# EasyEDA Pro project wukong01-Y003-HTOL - 2.eprj, board PCB1
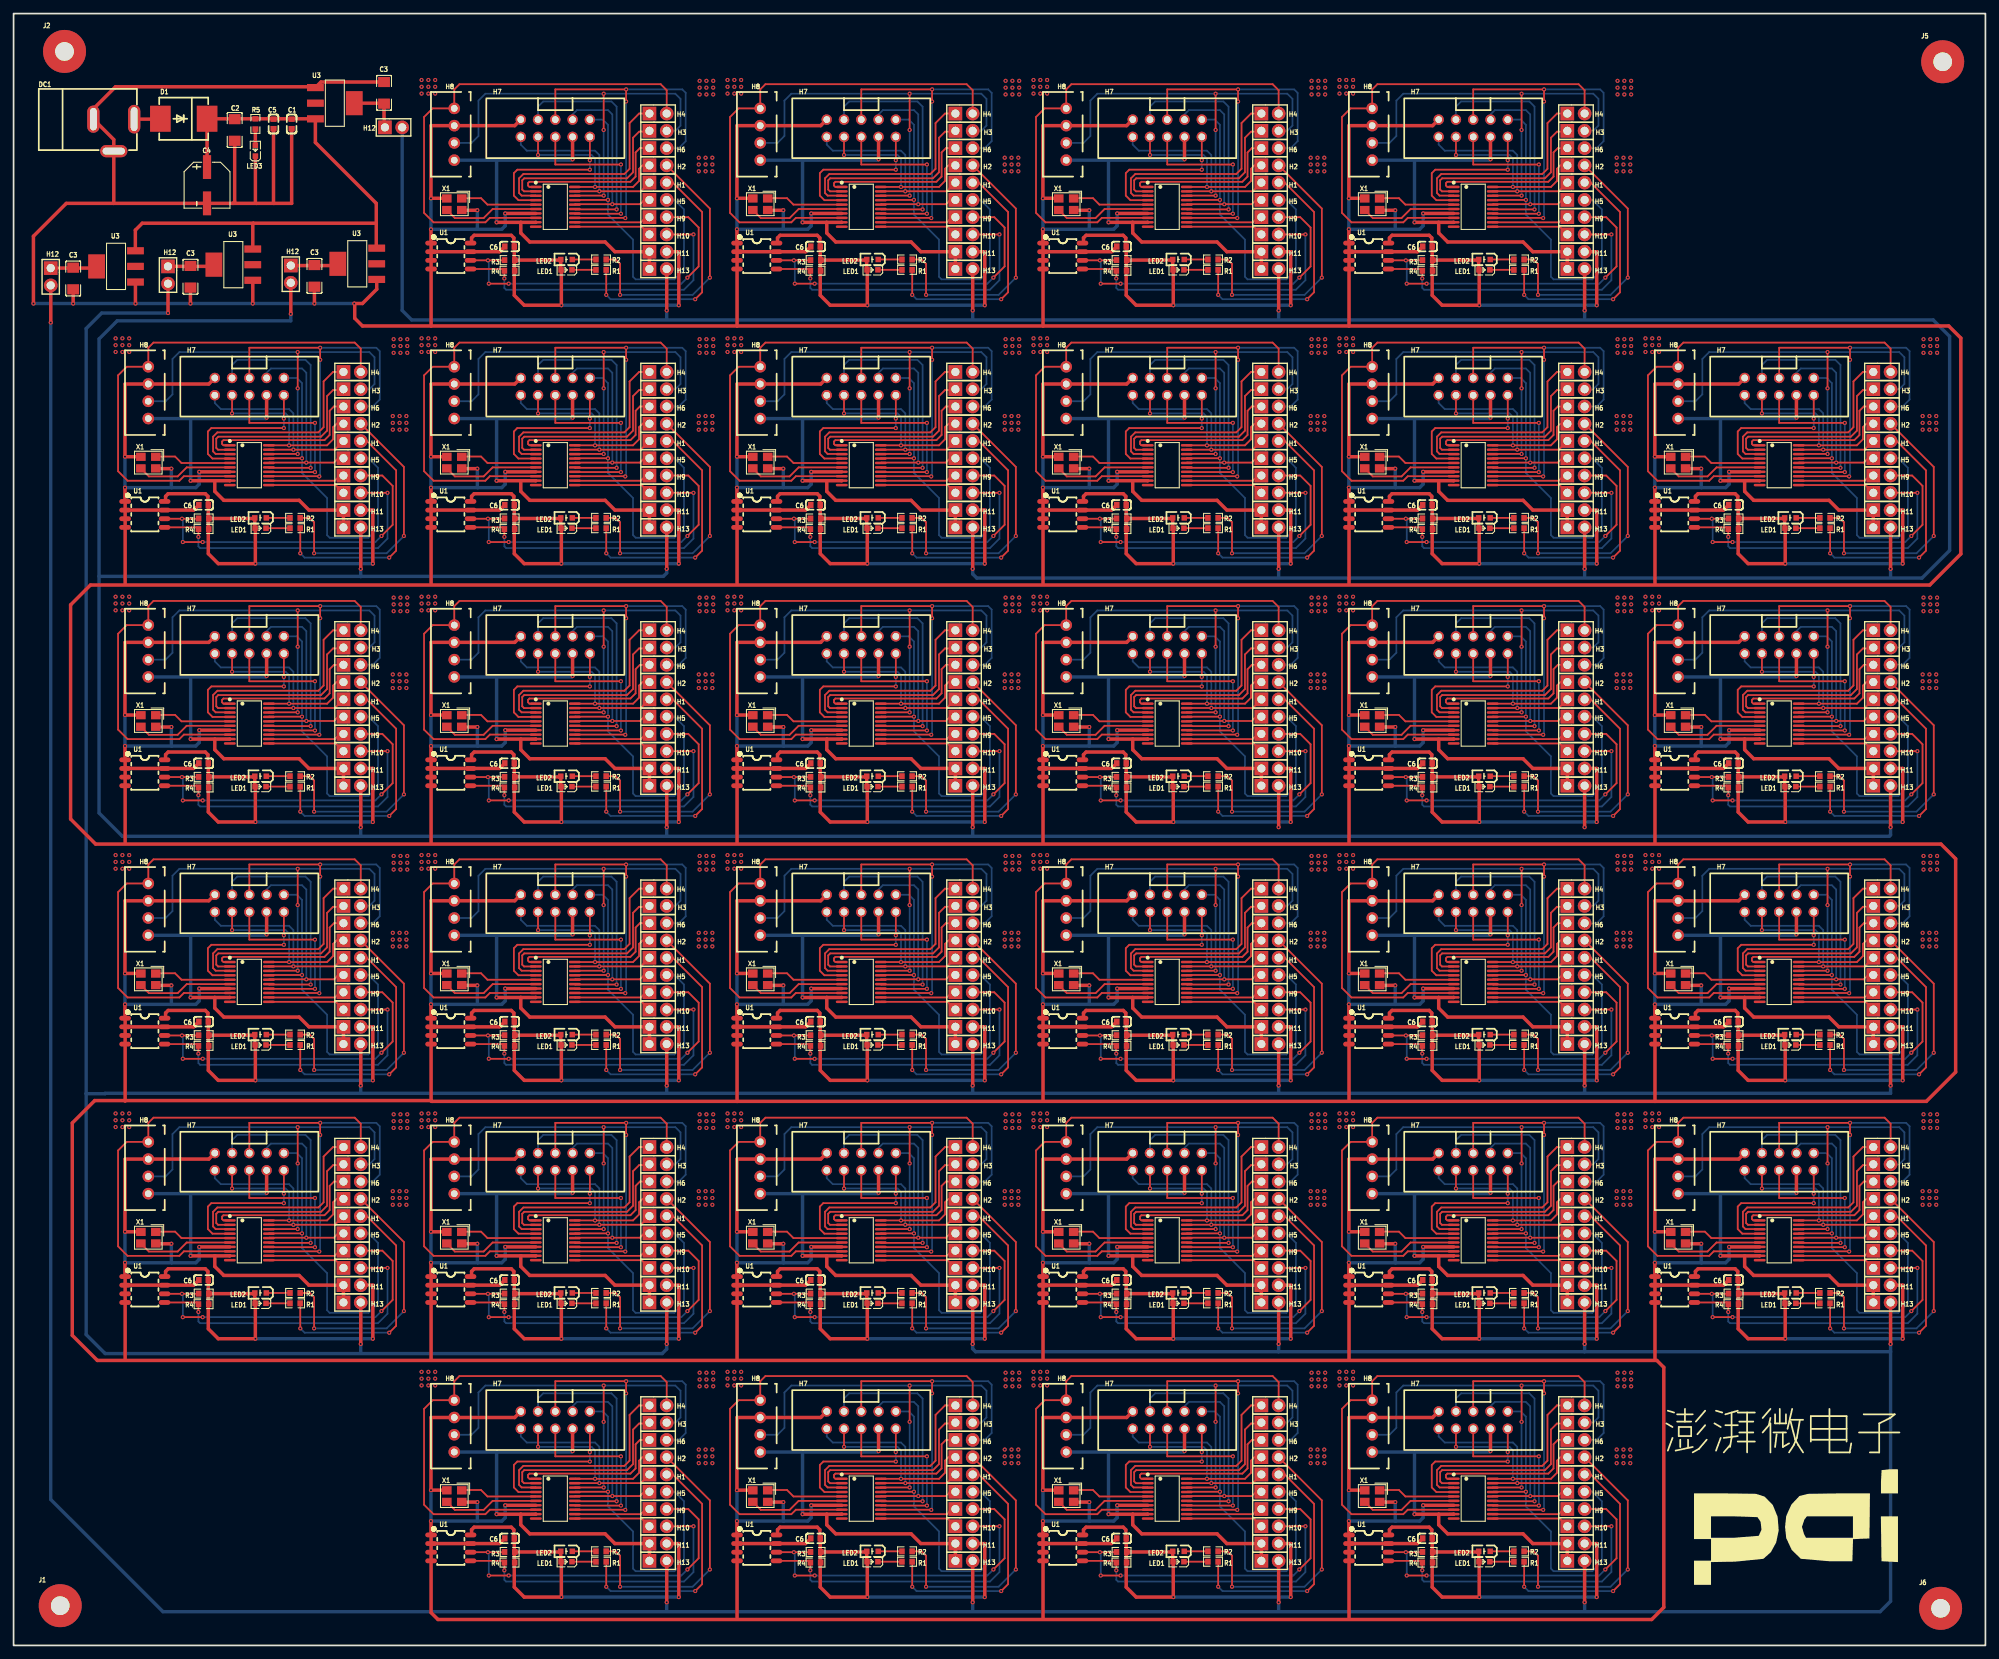
[diagram p1: board, top side]
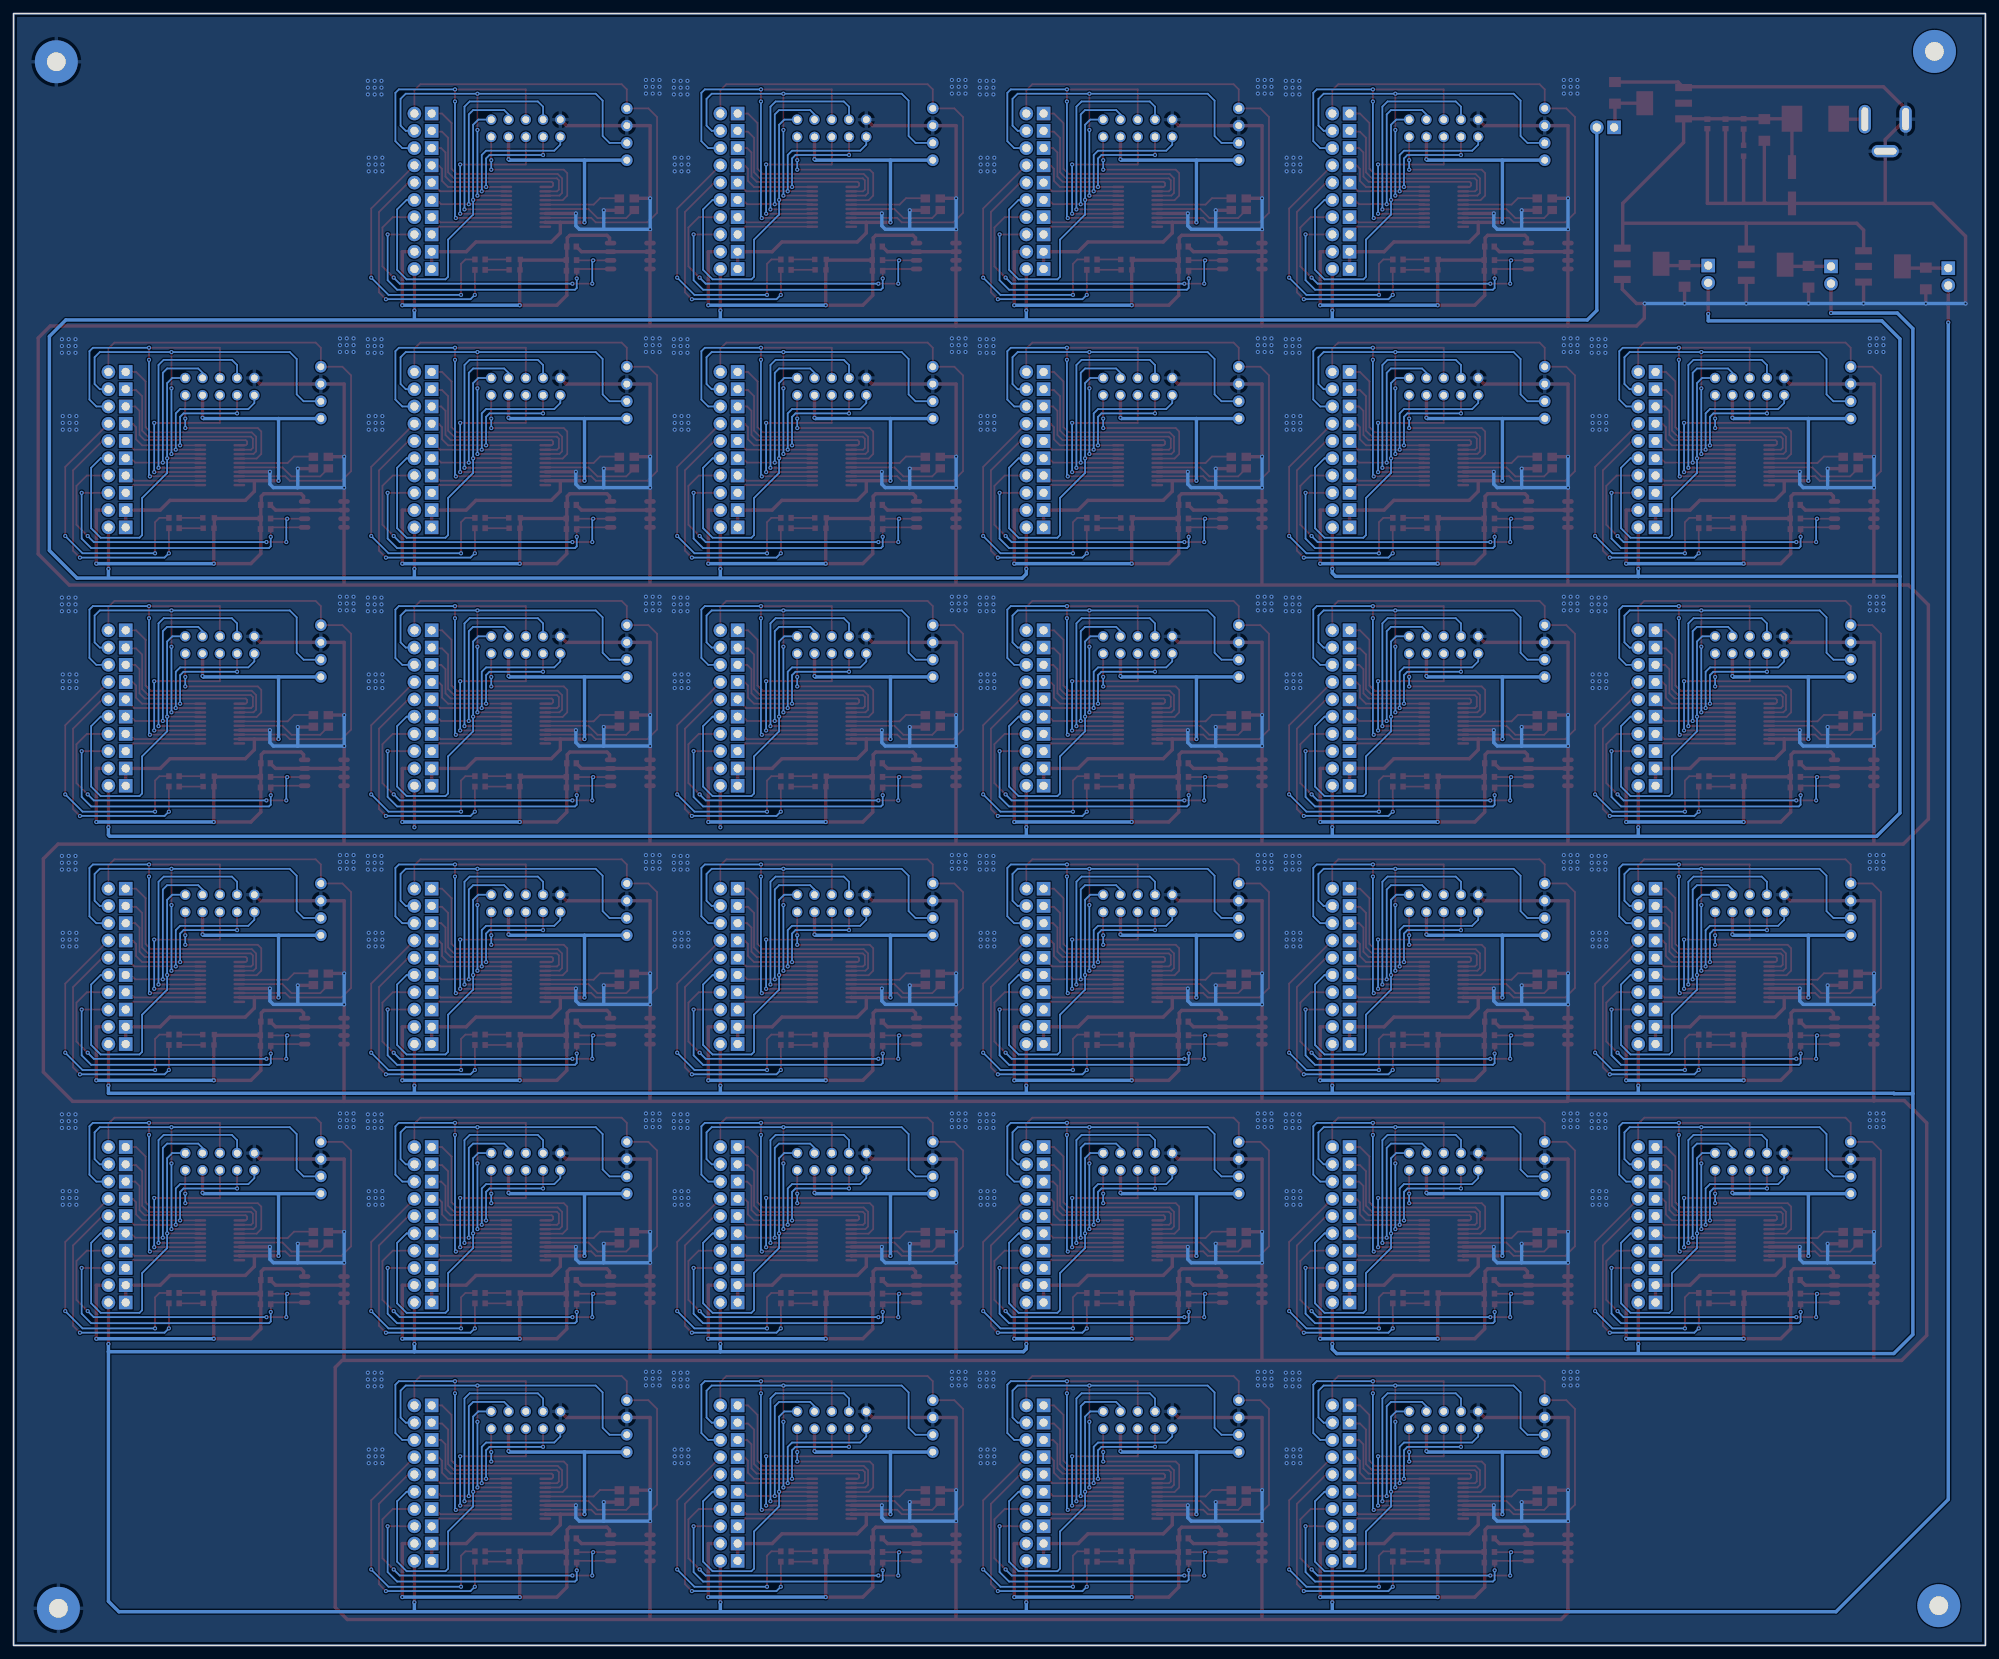
[diagram p2: board, bottom side, seen from below]

Outline 290 x 240 mm; copper layers: Top Layer, Bottom Layer. Coordinates in mm from the lower left corner of the outline.
Outline path: rectangle 0,240 290,0
Stack: Top Layer 0.035mm / Dielectric1 1.51mm FR4 er 4.5 / Bottom Layer 0.035mm

## Design rules (mm)
template: 自定义配置
spacing copperThickness1oz (default): track to track 0.102, other pairs 0.152 to 0.3
spacing copperThickness2oz: track to track 0.203, other pairs 0.152 to 0.3
track width copperThickness1oz (default): min 0.127, default 0.254, max 2.54
track width copperThickness2oz: min 0.203, default 0.254, max 2.54
differential pair differentialPair (default): width min 0.127, default 0.254, max 2.54; gap min 0.152, default 0.152
via viaSize (default): diameter min 0.5, default 0.61, max 10; hole min 0.3, default 0.305, max 6.299
pour e22403 uses copperRegion2

## Placement (name value [footprint] x y rotation side)
C1  100nF  [C0603]  40.89 223.77 90 top
C2  10uF  [C1206]  32.51 222.88 270 top
C3  10uF  [C1206]  8.76 201.04 90 top
C3#2  -  [C1206]  26.01 201.29 90 top
C3#3  -  [C1206]  44.24 201.42 90 top
C3#4  -  [C1206]  54.48 228.35 270 top
C4  100uF  [CAP-SMD_BD6.3-L6.6-W6.6-LS7.6-FD-1]  28.45 214.76 270 top
C5  100nF  [C0603]  38.23 223.77 90 top
C6  100nF  [C0603]  207.94 205.74 0 top
C6#2  -  [C0603]  72.94 205.74 0 top
C6#3  -  [C0603]  117.94 205.74 0 top
C6#4  -  [C0603]  162.94 205.74 0 top
C6#5  -  [C0603]  72.94 167.74 0 top
C6#6  -  [C0603]  117.94 167.74 0 top
C6#7  -  [C0603]  162.94 167.74 0 top
C6#8  -  [C0603]  207.94 167.74 0 top
C6#9  -  [C0603]  252.94 167.74 0 top
C6#10  -  [C0603]  27.94 167.74 0 top
C6#11  -  [C0603]  72.94 129.74 0 top
C6#12  -  [C0603]  117.94 129.74 0 top
C6#13  -  [C0603]  162.94 129.74 0 top
C6#14  -  [C0603]  207.94 129.74 0 top
C6#15  -  [C0603]  252.94 129.74 0 top
C6#16  -  [C0603]  27.94 129.74 0 top
C6#17  -  [C0603]  72.94 91.74 0 top
C6#18  -  [C0603]  117.94 91.74 0 top
C6#19  -  [C0603]  162.94 91.74 0 top
C6#20  -  [C0603]  207.94 91.74 0 top
C6#21  -  [C0603]  252.94 91.74 0 top
C6#22  -  [C0603]  27.94 91.74 0 top
C6#23  -  [C0603]  72.94 53.74 0 top
C6#24  -  [C0603]  117.94 53.74 0 top
C6#25  -  [C0603]  162.94 53.74 0 top
C6#26  -  [C0603]  207.94 53.74 0 top
C6#27  -  [C0603]  252.94 53.74 0 top
C6#28  -  [C0603]  27.94 53.74 0 top
C6#29  -  [C0603]  72.94 15.74 0 top
C6#30  -  [C0603]  117.94 15.74 0 top
C6#31  -  [C0603]  162.94 15.74 0 top
C6#32  -  [C0603]  207.94 15.74 0 top
D1  SS36-E3/57T  [SMC_L7.1-W6.2-LS8.1-R-RD]  25.02 224.54 180 top
DC1  DC-005-5A-2.0  [DC-IN-TH_DC-005-5A-2.0]  14.73 222.12 0 top
H1  PZ254V-11-02P  [HDR-TH_2P-P2.54-V-M]  94.78 215.14 0 top
H1#2  -  [HDR-TH_2P-P2.54-V-M]  139.78 215.14 0 top
H1#3  -  [HDR-TH_2P-P2.54-V-M]  184.78 215.14 0 top
H1#4  -  [HDR-TH_2P-P2.54-V-M]  229.78 215.14 0 top
H1#5  -  [HDR-TH_2P-P2.54-V-M]  229.78 177.14 0 top
H1#6  -  [HDR-TH_2P-P2.54-V-M]  94.78 177.14 0 top
H1#7  -  [HDR-TH_2P-P2.54-V-M]  139.78 177.14 0 top
H1#8  -  [HDR-TH_2P-P2.54-V-M]  184.78 177.14 0 top
H1#9  -  [HDR-TH_2P-P2.54-V-M]  274.78 177.14 0 top
H1#10  -  [HDR-TH_2P-P2.54-V-M]  49.78 177.14 0 top
H1#11  -  [HDR-TH_2P-P2.54-V-M]  229.78 139.14 0 top
H1#12  -  [HDR-TH_2P-P2.54-V-M]  94.78 139.14 0 top
H1#13  -  [HDR-TH_2P-P2.54-V-M]  139.78 139.14 0 top
H1#14  -  [HDR-TH_2P-P2.54-V-M]  184.78 139.14 0 top
H1#15  -  [HDR-TH_2P-P2.54-V-M]  274.78 139.14 0 top
H1#16  -  [HDR-TH_2P-P2.54-V-M]  49.78 139.14 0 top
H1#17  -  [HDR-TH_2P-P2.54-V-M]  229.78 101.14 0 top
H1#18  -  [HDR-TH_2P-P2.54-V-M]  94.78 101.14 0 top
H1#19  -  [HDR-TH_2P-P2.54-V-M]  139.78 101.14 0 top
H1#20  -  [HDR-TH_2P-P2.54-V-M]  184.78 101.14 0 top
H1#21  -  [HDR-TH_2P-P2.54-V-M]  274.78 101.14 0 top
H1#22  -  [HDR-TH_2P-P2.54-V-M]  49.78 101.14 0 top
H1#23  -  [HDR-TH_2P-P2.54-V-M]  229.78 63.14 0 top
H1#24  -  [HDR-TH_2P-P2.54-V-M]  94.78 63.14 0 top
H1#25  -  [HDR-TH_2P-P2.54-V-M]  139.78 63.14 0 top
H1#26  -  [HDR-TH_2P-P2.54-V-M]  184.78 63.14 0 top
H1#27  -  [HDR-TH_2P-P2.54-V-M]  274.78 63.14 0 top
H1#28  -  [HDR-TH_2P-P2.54-V-M]  49.78 63.14 0 top
H1#29  -  [HDR-TH_2P-P2.54-V-M]  229.78 25.14 0 top
H1#30  -  [HDR-TH_2P-P2.54-V-M]  94.78 25.14 0 top
H1#31  -  [HDR-TH_2P-P2.54-V-M]  139.78 25.14 0 top
H1#32  -  [HDR-TH_2P-P2.54-V-M]  184.78 25.14 0 top
H2  PZ254V-11-02P  [HDR-TH_2P-P2.54-V-M]  94.78 217.68 0 top
H2#2  -  [HDR-TH_2P-P2.54-V-M]  139.78 217.68 0 top
H2#3  -  [HDR-TH_2P-P2.54-V-M]  184.78 217.68 0 top
H2#4  -  [HDR-TH_2P-P2.54-V-M]  229.78 217.68 0 top
H2#5  -  [HDR-TH_2P-P2.54-V-M]  94.78 179.68 0 top
H2#6  -  [HDR-TH_2P-P2.54-V-M]  184.78 179.68 0 top
H2#7  -  [HDR-TH_2P-P2.54-V-M]  229.78 179.68 0 top
H2#8  -  [HDR-TH_2P-P2.54-V-M]  139.78 179.68 0 top
H2#9  -  [HDR-TH_2P-P2.54-V-M]  274.78 179.68 0 top
H2#10  -  [HDR-TH_2P-P2.54-V-M]  49.78 179.68 0 top
H2#11  -  [HDR-TH_2P-P2.54-V-M]  94.78 141.68 0 top
H2#12  -  [HDR-TH_2P-P2.54-V-M]  184.78 141.68 0 top
H2#13  -  [HDR-TH_2P-P2.54-V-M]  229.78 141.68 0 top
H2#14  -  [HDR-TH_2P-P2.54-V-M]  139.78 141.68 0 top
H2#15  -  [HDR-TH_2P-P2.54-V-M]  274.78 141.68 0 top
H2#16  -  [HDR-TH_2P-P2.54-V-M]  49.78 141.68 0 top
H2#17  -  [HDR-TH_2P-P2.54-V-M]  94.78 103.68 0 top
H2#18  -  [HDR-TH_2P-P2.54-V-M]  184.78 103.68 0 top
H2#19  -  [HDR-TH_2P-P2.54-V-M]  229.78 103.68 0 top
H2#20  -  [HDR-TH_2P-P2.54-V-M]  139.78 103.68 0 top
H2#21  -  [HDR-TH_2P-P2.54-V-M]  274.78 103.68 0 top
H2#22  -  [HDR-TH_2P-P2.54-V-M]  49.78 103.68 0 top
H2#23  -  [HDR-TH_2P-P2.54-V-M]  94.78 65.68 0 top
H2#24  -  [HDR-TH_2P-P2.54-V-M]  184.78 65.68 0 top
H2#25  -  [HDR-TH_2P-P2.54-V-M]  229.78 65.68 0 top
H2#26  -  [HDR-TH_2P-P2.54-V-M]  139.78 65.68 0 top
H2#27  -  [HDR-TH_2P-P2.54-V-M]  274.78 65.68 0 top
H2#28  -  [HDR-TH_2P-P2.54-V-M]  49.78 65.68 0 top
H2#29  -  [HDR-TH_2P-P2.54-V-M]  94.78 27.68 0 top
H2#30  -  [HDR-TH_2P-P2.54-V-M]  184.78 27.68 0 top
H2#31  -  [HDR-TH_2P-P2.54-V-M]  229.78 27.68 0 top
H2#32  -  [HDR-TH_2P-P2.54-V-M]  139.78 27.68 0 top
H3  PZ254V-11-02P  [HDR-TH_2P-P2.54-V-M]  94.78 222.76 0 top
H3#2  -  [HDR-TH_2P-P2.54-V-M]  139.78 222.76 0 top
H3#3  -  [HDR-TH_2P-P2.54-V-M]  184.78 222.76 0 top
H3#4  -  [HDR-TH_2P-P2.54-V-M]  229.78 222.76 0 top
H3#5  -  [HDR-TH_2P-P2.54-V-M]  94.78 184.76 0 top
H3#6  -  [HDR-TH_2P-P2.54-V-M]  229.78 184.76 0 top
H3#7  -  [HDR-TH_2P-P2.54-V-M]  139.78 184.76 0 top
H3#8  -  [HDR-TH_2P-P2.54-V-M]  184.78 184.76 0 top
H3#9  -  [HDR-TH_2P-P2.54-V-M]  274.78 184.76 0 top
H3#10  -  [HDR-TH_2P-P2.54-V-M]  49.78 184.76 0 top
H3#11  -  [HDR-TH_2P-P2.54-V-M]  94.78 146.76 0 top
H3#12  -  [HDR-TH_2P-P2.54-V-M]  139.78 70.76 0 top
H3#13  -  [HDR-TH_2P-P2.54-V-M]  229.78 146.76 0 top
H3#14  -  [HDR-TH_2P-P2.54-V-M]  139.78 146.76 0 top
H3#15  -  [HDR-TH_2P-P2.54-V-M]  184.78 146.76 0 top
H3#16  -  [HDR-TH_2P-P2.54-V-M]  274.78 146.76 0 top
H3#17  -  [HDR-TH_2P-P2.54-V-M]  49.78 146.76 0 top
H3#18  -  [HDR-TH_2P-P2.54-V-M]  94.78 108.76 0 top
H3#19  -  [HDR-TH_2P-P2.54-V-M]  229.78 108.76 0 top
H3#20  -  [HDR-TH_2P-P2.54-V-M]  139.78 108.76 0 top
H3#21  -  [HDR-TH_2P-P2.54-V-M]  184.78 108.76 0 top
H3#22  -  [HDR-TH_2P-P2.54-V-M]  274.78 108.76 0 top
H3#23  -  [HDR-TH_2P-P2.54-V-M]  49.78 108.76 0 top
H3#24  -  [HDR-TH_2P-P2.54-V-M]  94.78 70.76 0 top
H3#25  -  [HDR-TH_2P-P2.54-V-M]  229.78 70.76 0 top
H3#26  -  [HDR-TH_2P-P2.54-V-M]  184.78 70.76 0 top
H3#27  -  [HDR-TH_2P-P2.54-V-M]  274.78 70.76 0 top
H3#28  -  [HDR-TH_2P-P2.54-V-M]  49.78 70.76 0 top
H3#29  -  [HDR-TH_2P-P2.54-V-M]  94.78 32.76 0 top
H3#30  -  [HDR-TH_2P-P2.54-V-M]  229.78 32.76 0 top
H3#31  -  [HDR-TH_2P-P2.54-V-M]  139.78 32.76 0 top
H3#32  -  [HDR-TH_2P-P2.54-V-M]  184.78 32.76 0 top
H4  PZ254V-11-02P  [HDR-TH_2P-P2.54-V-M]  94.78 225.3 0 top
H4#2  -  [HDR-TH_2P-P2.54-V-M]  139.78 225.3 0 top
H4#3  -  [HDR-TH_2P-P2.54-V-M]  184.78 225.3 0 top
H4#4  -  [HDR-TH_2P-P2.54-V-M]  229.78 225.3 0 top
H4#5  -  [HDR-TH_2P-P2.54-V-M]  229.78 187.3 0 top
H4#6  -  [HDR-TH_2P-P2.54-V-M]  94.78 187.3 0 top
H4#7  -  [HDR-TH_2P-P2.54-V-M]  139.78 187.3 0 top
H4#8  -  [HDR-TH_2P-P2.54-V-M]  49.78 187.3 0 top
H4#9  -  [HDR-TH_2P-P2.54-V-M]  184.78 187.3 0 top
H4#10  -  [HDR-TH_2P-P2.54-V-M]  274.78 187.3 0 top
H4#11  -  [HDR-TH_2P-P2.54-V-M]  229.78 149.3 0 top
H4#12  -  [HDR-TH_2P-P2.54-V-M]  94.78 149.3 0 top
H4#13  -  [HDR-TH_2P-P2.54-V-M]  139.78 149.3 0 top
H4#14  -  [HDR-TH_2P-P2.54-V-M]  49.78 149.3 0 top
H4#15  -  [HDR-TH_2P-P2.54-V-M]  184.78 149.3 0 top
H4#16  -  [HDR-TH_2P-P2.54-V-M]  274.78 149.3 0 top
H4#17  -  [HDR-TH_2P-P2.54-V-M]  229.78 111.3 0 top
H4#18  -  [HDR-TH_2P-P2.54-V-M]  94.78 111.3 0 top
H4#19  -  [HDR-TH_2P-P2.54-V-M]  139.78 111.3 0 top
H4#20  -  [HDR-TH_2P-P2.54-V-M]  49.78 111.3 0 top
H4#21  -  [HDR-TH_2P-P2.54-V-M]  184.78 111.3 0 top
H4#22  -  [HDR-TH_2P-P2.54-V-M]  274.78 111.3 0 top
H4#23  -  [HDR-TH_2P-P2.54-V-M]  229.78 73.3 0 top
H4#24  -  [HDR-TH_2P-P2.54-V-M]  94.78 73.3 0 top
H4#25  -  [HDR-TH_2P-P2.54-V-M]  139.78 73.3 0 top
H4#26  -  [HDR-TH_2P-P2.54-V-M]  49.78 73.3 0 top
H4#27  -  [HDR-TH_2P-P2.54-V-M]  184.78 73.3 0 top
H4#28  -  [HDR-TH_2P-P2.54-V-M]  274.78 73.3 0 top
H4#29  -  [HDR-TH_2P-P2.54-V-M]  229.78 35.3 0 top
H4#30  -  [HDR-TH_2P-P2.54-V-M]  94.78 35.3 0 top
H4#31  -  [HDR-TH_2P-P2.54-V-M]  139.78 35.3 0 top
H4#32  -  [HDR-TH_2P-P2.54-V-M]  184.78 35.3 0 top
H5  PZ254V-11-02P  [HDR-TH_2P-P2.54-V-M]  229.78 212.6 0 top
H5#2  -  [HDR-TH_2P-P2.54-V-M]  94.78 212.6 0 top
H5#3  -  [HDR-TH_2P-P2.54-V-M]  139.78 212.6 0 top
H5#4  -  [HDR-TH_2P-P2.54-V-M]  184.78 212.6 0 top
H5#5  -  [HDR-TH_2P-P2.54-V-M]  229.78 174.6 0 top
H5#6  -  [HDR-TH_2P-P2.54-V-M]  139.78 174.6 0 top
H5#7  -  [HDR-TH_2P-P2.54-V-M]  94.78 174.6 0 top
H5#8  -  [HDR-TH_2P-P2.54-V-M]  184.78 174.6 0 top
H5#9  -  [HDR-TH_2P-P2.54-V-M]  274.78 174.6 0 top
H5#10  -  [HDR-TH_2P-P2.54-V-M]  49.78 174.6 0 top
H5#11  -  [HDR-TH_2P-P2.54-V-M]  229.78 136.6 0 top
H5#12  -  [HDR-TH_2P-P2.54-V-M]  139.78 136.6 0 top
H5#13  -  [HDR-TH_2P-P2.54-V-M]  94.78 136.6 0 top
H5#14  -  [HDR-TH_2P-P2.54-V-M]  184.78 136.6 0 top
H5#15  -  [HDR-TH_2P-P2.54-V-M]  274.78 136.6 0 top
H5#16  -  [HDR-TH_2P-P2.54-V-M]  49.78 136.6 0 top
H5#17  -  [HDR-TH_2P-P2.54-V-M]  229.78 98.6 0 top
H5#18  -  [HDR-TH_2P-P2.54-V-M]  139.78 98.6 0 top
H5#19  -  [HDR-TH_2P-P2.54-V-M]  94.78 98.6 0 top
H5#20  -  [HDR-TH_2P-P2.54-V-M]  184.78 98.6 0 top
H5#21  -  [HDR-TH_2P-P2.54-V-M]  274.78 98.6 0 top
H5#22  -  [HDR-TH_2P-P2.54-V-M]  49.78 98.6 0 top
H5#23  -  [HDR-TH_2P-P2.54-V-M]  229.78 60.6 0 top
H5#24  -  [HDR-TH_2P-P2.54-V-M]  139.78 60.6 0 top
H5#25  -  [HDR-TH_2P-P2.54-V-M]  94.78 60.6 0 top
H5#26  -  [HDR-TH_2P-P2.54-V-M]  184.78 60.6 0 top
H5#27  -  [HDR-TH_2P-P2.54-V-M]  274.78 60.6 0 top
H5#28  -  [HDR-TH_2P-P2.54-V-M]  49.78 60.6 0 top
H5#29  -  [HDR-TH_2P-P2.54-V-M]  229.78 22.6 0 top
H5#30  -  [HDR-TH_2P-P2.54-V-M]  139.78 22.6 0 top
H5#31  -  [HDR-TH_2P-P2.54-V-M]  94.78 22.6 0 top
H5#32  -  [HDR-TH_2P-P2.54-V-M]  184.78 22.6 0 top
H6  PZ254V-11-02P  [HDR-TH_2P-P2.54-V-M]  94.78 220.22 0 top
H6#2  -  [HDR-TH_2P-P2.54-V-M]  139.78 220.22 0 top
H6#3  -  [HDR-TH_2P-P2.54-V-M]  184.78 220.22 0 top
H6#4  -  [HDR-TH_2P-P2.54-V-M]  229.78 220.22 0 top
H6#5  -  [HDR-TH_2P-P2.54-V-M]  94.78 182.22 0 top
H6#6  -  [HDR-TH_2P-P2.54-V-M]  229.78 182.22 0 top
H6#7  -  [HDR-TH_2P-P2.54-V-M]  139.78 182.22 0 top
H6#8  -  [HDR-TH_2P-P2.54-V-M]  184.78 182.22 0 top
H6#9  -  [HDR-TH_2P-P2.54-V-M]  274.78 182.22 0 top
H6#10  -  [HDR-TH_2P-P2.54-V-M]  49.78 182.22 0 top
H6#11  -  [HDR-TH_2P-P2.54-V-M]  94.78 144.22 0 top
H6#12  -  [HDR-TH_2P-P2.54-V-M]  229.78 144.22 0 top
H6#13  -  [HDR-TH_2P-P2.54-V-M]  139.78 144.22 0 top
H6#14  -  [HDR-TH_2P-P2.54-V-M]  184.78 144.22 0 top
H6#15  -  [HDR-TH_2P-P2.54-V-M]  274.78 144.22 0 top
H6#16  -  [HDR-TH_2P-P2.54-V-M]  49.78 144.22 0 top
H6#17  -  [HDR-TH_2P-P2.54-V-M]  94.78 106.22 0 top
H6#18  -  [HDR-TH_2P-P2.54-V-M]  229.78 106.22 0 top
H6#19  -  [HDR-TH_2P-P2.54-V-M]  139.78 106.22 0 top
H6#20  -  [HDR-TH_2P-P2.54-V-M]  184.78 106.22 0 top
H6#21  -  [HDR-TH_2P-P2.54-V-M]  274.78 106.22 0 top
H6#22  -  [HDR-TH_2P-P2.54-V-M]  49.78 106.22 0 top
H6#23  -  [HDR-TH_2P-P2.54-V-M]  94.78 68.22 0 top
H6#24  -  [HDR-TH_2P-P2.54-V-M]  229.78 68.22 0 top
H6#25  -  [HDR-TH_2P-P2.54-V-M]  139.78 68.22 0 top
H6#26  -  [HDR-TH_2P-P2.54-V-M]  184.78 68.22 0 top
H6#27  -  [HDR-TH_2P-P2.54-V-M]  274.78 68.22 0 top
H6#28  -  [HDR-TH_2P-P2.54-V-M]  49.78 68.22 0 top
H6#29  -  [HDR-TH_2P-P2.54-V-M]  94.78 30.22 0 top
H6#30  -  [HDR-TH_2P-P2.54-V-M]  229.78 30.22 0 top
H6#31  -  [HDR-TH_2P-P2.54-V-M]  139.78 30.22 0 top
H6#32  -  [HDR-TH_2P-P2.54-V-M]  184.78 30.22 0 top
H7  2.54-2*5P简牛  [IDC-TH_10P-P2.54_C5665]  79.67 223.14 180 top
H7#2  -  [IDC-TH_10P-P2.54_C5665]  124.67 223.14 180 top
H7#3  -  [IDC-TH_10P-P2.54_C5665]  169.67 223.14 180 top
H7#4  -  [IDC-TH_10P-P2.54_C5665]  214.67 223.14 180 top
H7#5  -  [IDC-TH_10P-P2.54_C5665]  79.67 185.14 180 top
H7#6  -  [IDC-TH_10P-P2.54_C5665]  124.67 185.14 180 top
H7#7  -  [IDC-TH_10P-P2.54_C5665]  169.67 185.14 180 top
H7#8  -  [IDC-TH_10P-P2.54_C5665]  214.67 185.14 180 top
H7#9  -  [IDC-TH_10P-P2.54_C5665]  34.67 185.14 180 top
H7#10  -  [IDC-TH_10P-P2.54_C5665]  259.67 185.14 180 top
H7#11  -  [IDC-TH_10P-P2.54_C5665]  79.67 147.14 180 top
H7#12  -  [IDC-TH_10P-P2.54_C5665]  124.67 147.14 180 top
H7#13  -  [IDC-TH_10P-P2.54_C5665]  169.67 147.14 180 top
H7#14  -  [IDC-TH_10P-P2.54_C5665]  214.67 147.14 180 top
H7#15  -  [IDC-TH_10P-P2.54_C5665]  34.67 147.14 180 top
H7#16  -  [IDC-TH_10P-P2.54_C5665]  259.67 147.14 180 top
H7#17  -  [IDC-TH_10P-P2.54_C5665]  79.67 109.14 180 top
H7#18  -  [IDC-TH_10P-P2.54_C5665]  124.67 109.14 180 top
H7#19  -  [IDC-TH_10P-P2.54_C5665]  169.67 109.14 180 top
H7#20  -  [IDC-TH_10P-P2.54_C5665]  214.67 109.14 180 top
H7#21  -  [IDC-TH_10P-P2.54_C5665]  34.67 109.14 180 top
H7#22  -  [IDC-TH_10P-P2.54_C5665]  259.67 109.14 180 top
H7#23  -  [IDC-TH_10P-P2.54_C5665]  79.67 71.14 180 top
H7#24  -  [IDC-TH_10P-P2.54_C5665]  124.67 71.14 180 top
H7#25  -  [IDC-TH_10P-P2.54_C5665]  169.67 71.14 180 top
H7#26  -  [IDC-TH_10P-P2.54_C5665]  214.67 71.14 180 top
H7#27  -  [IDC-TH_10P-P2.54_C5665]  34.67 71.14 180 top
H7#28  -  [IDC-TH_10P-P2.54_C5665]  259.67 71.14 180 top
H7#29  -  [IDC-TH_10P-P2.54_C5665]  79.67 33.14 180 top
H7#30  -  [IDC-TH_10P-P2.54_C5665]  124.67 33.14 180 top
H7#31  -  [IDC-TH_10P-P2.54_C5665]  169.67 33.14 180 top
H7#32  -  [IDC-TH_10P-P2.54_C5665]  214.67 33.14 180 top
H8  B4B-XH-A(LF)(SN)  [CONN-TH_B4B-XH-A-LF-SN]  64.81 222.25 90 top
H8#2  -  [CONN-TH_B4B-XH-A-LF-SN]  109.81 222.25 90 top
H8#3  -  [CONN-TH_B4B-XH-A-LF-SN]  154.81 222.25 90 top
H8#4  -  [CONN-TH_B4B-XH-A-LF-SN]  199.81 222.25 90 top
H8#5  -  [CONN-TH_B4B-XH-A-LF-SN]  64.81 184.25 90 top
H8#6  -  [CONN-TH_B4B-XH-A-LF-SN]  109.81 184.25 90 top
H8#7  -  [CONN-TH_B4B-XH-A-LF-SN]  199.81 184.25 90 top
H8#8  -  [CONN-TH_B4B-XH-A-LF-SN]  19.81 184.25 90 top
H8#9  -  [CONN-TH_B4B-XH-A-LF-SN]  154.81 184.25 90 top
H8#10  -  [CONN-TH_B4B-XH-A-LF-SN]  244.81 184.25 90 top
H8#11  -  [CONN-TH_B4B-XH-A-LF-SN]  64.81 146.25 90 top
H8#12  -  [CONN-TH_B4B-XH-A-LF-SN]  109.81 146.25 90 top
H8#13  -  [CONN-TH_B4B-XH-A-LF-SN]  199.81 146.25 90 top
H8#14  -  [CONN-TH_B4B-XH-A-LF-SN]  19.81 146.25 90 top
H8#15  -  [CONN-TH_B4B-XH-A-LF-SN]  154.81 146.25 90 top
H8#16  -  [CONN-TH_B4B-XH-A-LF-SN]  244.81 146.25 90 top
H8#17  -  [CONN-TH_B4B-XH-A-LF-SN]  64.81 108.25 90 top
H8#18  -  [CONN-TH_B4B-XH-A-LF-SN]  109.81 108.25 90 top
H8#19  -  [CONN-TH_B4B-XH-A-LF-SN]  199.81 108.25 90 top
H8#20  -  [CONN-TH_B4B-XH-A-LF-SN]  19.81 108.25 90 top
H8#21  -  [CONN-TH_B4B-XH-A-LF-SN]  154.81 108.25 90 top
H8#22  -  [CONN-TH_B4B-XH-A-LF-SN]  244.81 108.25 90 top
H8#23  -  [CONN-TH_B4B-XH-A-LF-SN]  64.81 70.25 90 top
H8#24  -  [CONN-TH_B4B-XH-A-LF-SN]  109.81 70.25 90 top
H8#25  -  [CONN-TH_B4B-XH-A-LF-SN]  199.81 70.25 90 top
H8#26  -  [CONN-TH_B4B-XH-A-LF-SN]  19.81 70.25 90 top
H8#27  -  [CONN-TH_B4B-XH-A-LF-SN]  154.81 70.25 90 top
H8#28  -  [CONN-TH_B4B-XH-A-LF-SN]  244.81 70.25 90 top
H8#29  -  [CONN-TH_B4B-XH-A-LF-SN]  64.81 32.25 90 top
H8#30  -  [CONN-TH_B4B-XH-A-LF-SN]  109.81 32.25 90 top
H8#31  -  [CONN-TH_B4B-XH-A-LF-SN]  199.81 32.25 90 top
H8#32  -  [CONN-TH_B4B-XH-A-LF-SN]  154.81 32.25 90 top
H9  PZ254V-11-02P  [HDR-TH_2P-P2.54-V-M]  94.78 210.06 0 top
H9#2  -  [HDR-TH_2P-P2.54-V-M]  139.78 210.06 0 top
H9#3  -  [HDR-TH_2P-P2.54-V-M]  184.78 210.06 0 top
H9#4  -  [HDR-TH_2P-P2.54-V-M]  229.78 210.06 0 top
H9#5  -  [HDR-TH_2P-P2.54-V-M]  229.78 172.06 0 top
H9#6  -  [HDR-TH_2P-P2.54-V-M]  94.78 172.06 0 top
H9#7  -  [HDR-TH_2P-P2.54-V-M]  139.78 172.06 0 top
H9#8  -  [HDR-TH_2P-P2.54-V-M]  184.78 172.06 0 top
H9#9  -  [HDR-TH_2P-P2.54-V-M]  274.78 172.06 0 top
H9#10  -  [HDR-TH_2P-P2.54-V-M]  49.78 172.06 0 top
H9#11  -  [HDR-TH_2P-P2.54-V-M]  229.78 134.06 0 top
H9#12  -  [HDR-TH_2P-P2.54-V-M]  94.78 134.06 0 top
H9#13  -  [HDR-TH_2P-P2.54-V-M]  139.78 134.06 0 top
H9#14  -  [HDR-TH_2P-P2.54-V-M]  184.78 134.06 0 top
H9#15  -  [HDR-TH_2P-P2.54-V-M]  274.78 134.06 0 top
H9#16  -  [HDR-TH_2P-P2.54-V-M]  49.78 134.06 0 top
H9#17  -  [HDR-TH_2P-P2.54-V-M]  229.78 96.06 0 top
H9#18  -  [HDR-TH_2P-P2.54-V-M]  94.78 96.06 0 top
H9#19  -  [HDR-TH_2P-P2.54-V-M]  139.78 96.06 0 top
H9#20  -  [HDR-TH_2P-P2.54-V-M]  184.78 96.06 0 top
H9#21  -  [HDR-TH_2P-P2.54-V-M]  274.78 96.06 0 top
H9#22  -  [HDR-TH_2P-P2.54-V-M]  49.78 96.06 0 top
H9#23  -  [HDR-TH_2P-P2.54-V-M]  229.78 58.06 0 top
H9#24  -  [HDR-TH_2P-P2.54-V-M]  94.78 58.06 0 top
H9#25  -  [HDR-TH_2P-P2.54-V-M]  139.78 58.06 0 top
H9#26  -  [HDR-TH_2P-P2.54-V-M]  184.78 58.06 0 top
H9#27  -  [HDR-TH_2P-P2.54-V-M]  274.78 58.06 0 top
H9#28  -  [HDR-TH_2P-P2.54-V-M]  49.78 58.06 0 top
H9#29  -  [HDR-TH_2P-P2.54-V-M]  229.78 20.06 0 top
H9#30  -  [HDR-TH_2P-P2.54-V-M]  94.78 20.06 0 top
H9#31  -  [HDR-TH_2P-P2.54-V-M]  139.78 20.06 0 top
H9#32  -  [HDR-TH_2P-P2.54-V-M]  184.78 20.06 0 top
H10  PZ254V-11-02P  [HDR-TH_2P-P2.54-V-M]  94.78 207.52 0 top
H10#2  -  [HDR-TH_2P-P2.54-V-M]  139.78 207.52 0 top
H10#3  -  [HDR-TH_2P-P2.54-V-M]  184.78 207.52 0 top
H10#4  -  [HDR-TH_2P-P2.54-V-M]  229.78 207.52 0 top
H10#5  -  [HDR-TH_2P-P2.54-V-M]  229.78 169.52 0 top
H10#6  -  [HDR-TH_2P-P2.54-V-M]  94.78 169.52 0 top
H10#7  -  [HDR-TH_2P-P2.54-V-M]  139.78 169.52 0 top
H10#8  -  [HDR-TH_2P-P2.54-V-M]  184.78 169.52 0 top
H10#9  -  [HDR-TH_2P-P2.54-V-M]  274.78 169.52 0 top
H10#10  -  [HDR-TH_2P-P2.54-V-M]  49.78 169.52 0 top
H10#11  -  [HDR-TH_2P-P2.54-V-M]  229.78 131.52 0 top
H10#12  -  [HDR-TH_2P-P2.54-V-M]  94.78 131.52 0 top
H10#13  -  [HDR-TH_2P-P2.54-V-M]  139.78 131.52 0 top
H10#14  -  [HDR-TH_2P-P2.54-V-M]  184.78 131.52 0 top
H10#15  -  [HDR-TH_2P-P2.54-V-M]  274.78 131.52 0 top
H10#16  -  [HDR-TH_2P-P2.54-V-M]  49.78 131.52 0 top
H10#17  -  [HDR-TH_2P-P2.54-V-M]  229.78 93.52 0 top
H10#18  -  [HDR-TH_2P-P2.54-V-M]  94.78 93.52 0 top
H10#19  -  [HDR-TH_2P-P2.54-V-M]  139.78 93.52 0 top
H10#20  -  [HDR-TH_2P-P2.54-V-M]  184.78 93.52 0 top
H10#21  -  [HDR-TH_2P-P2.54-V-M]  274.78 93.52 0 top
H10#22  -  [HDR-TH_2P-P2.54-V-M]  49.78 93.52 0 top
H10#23  -  [HDR-TH_2P-P2.54-V-M]  229.78 55.52 0 top